# EasyEDA Pro project ProProject_Avaota Pi A_2024-03-25.epro, schematic Avaota Pi A, sheets 1 to 5 of 13 (continued)
## Sheets (continued)
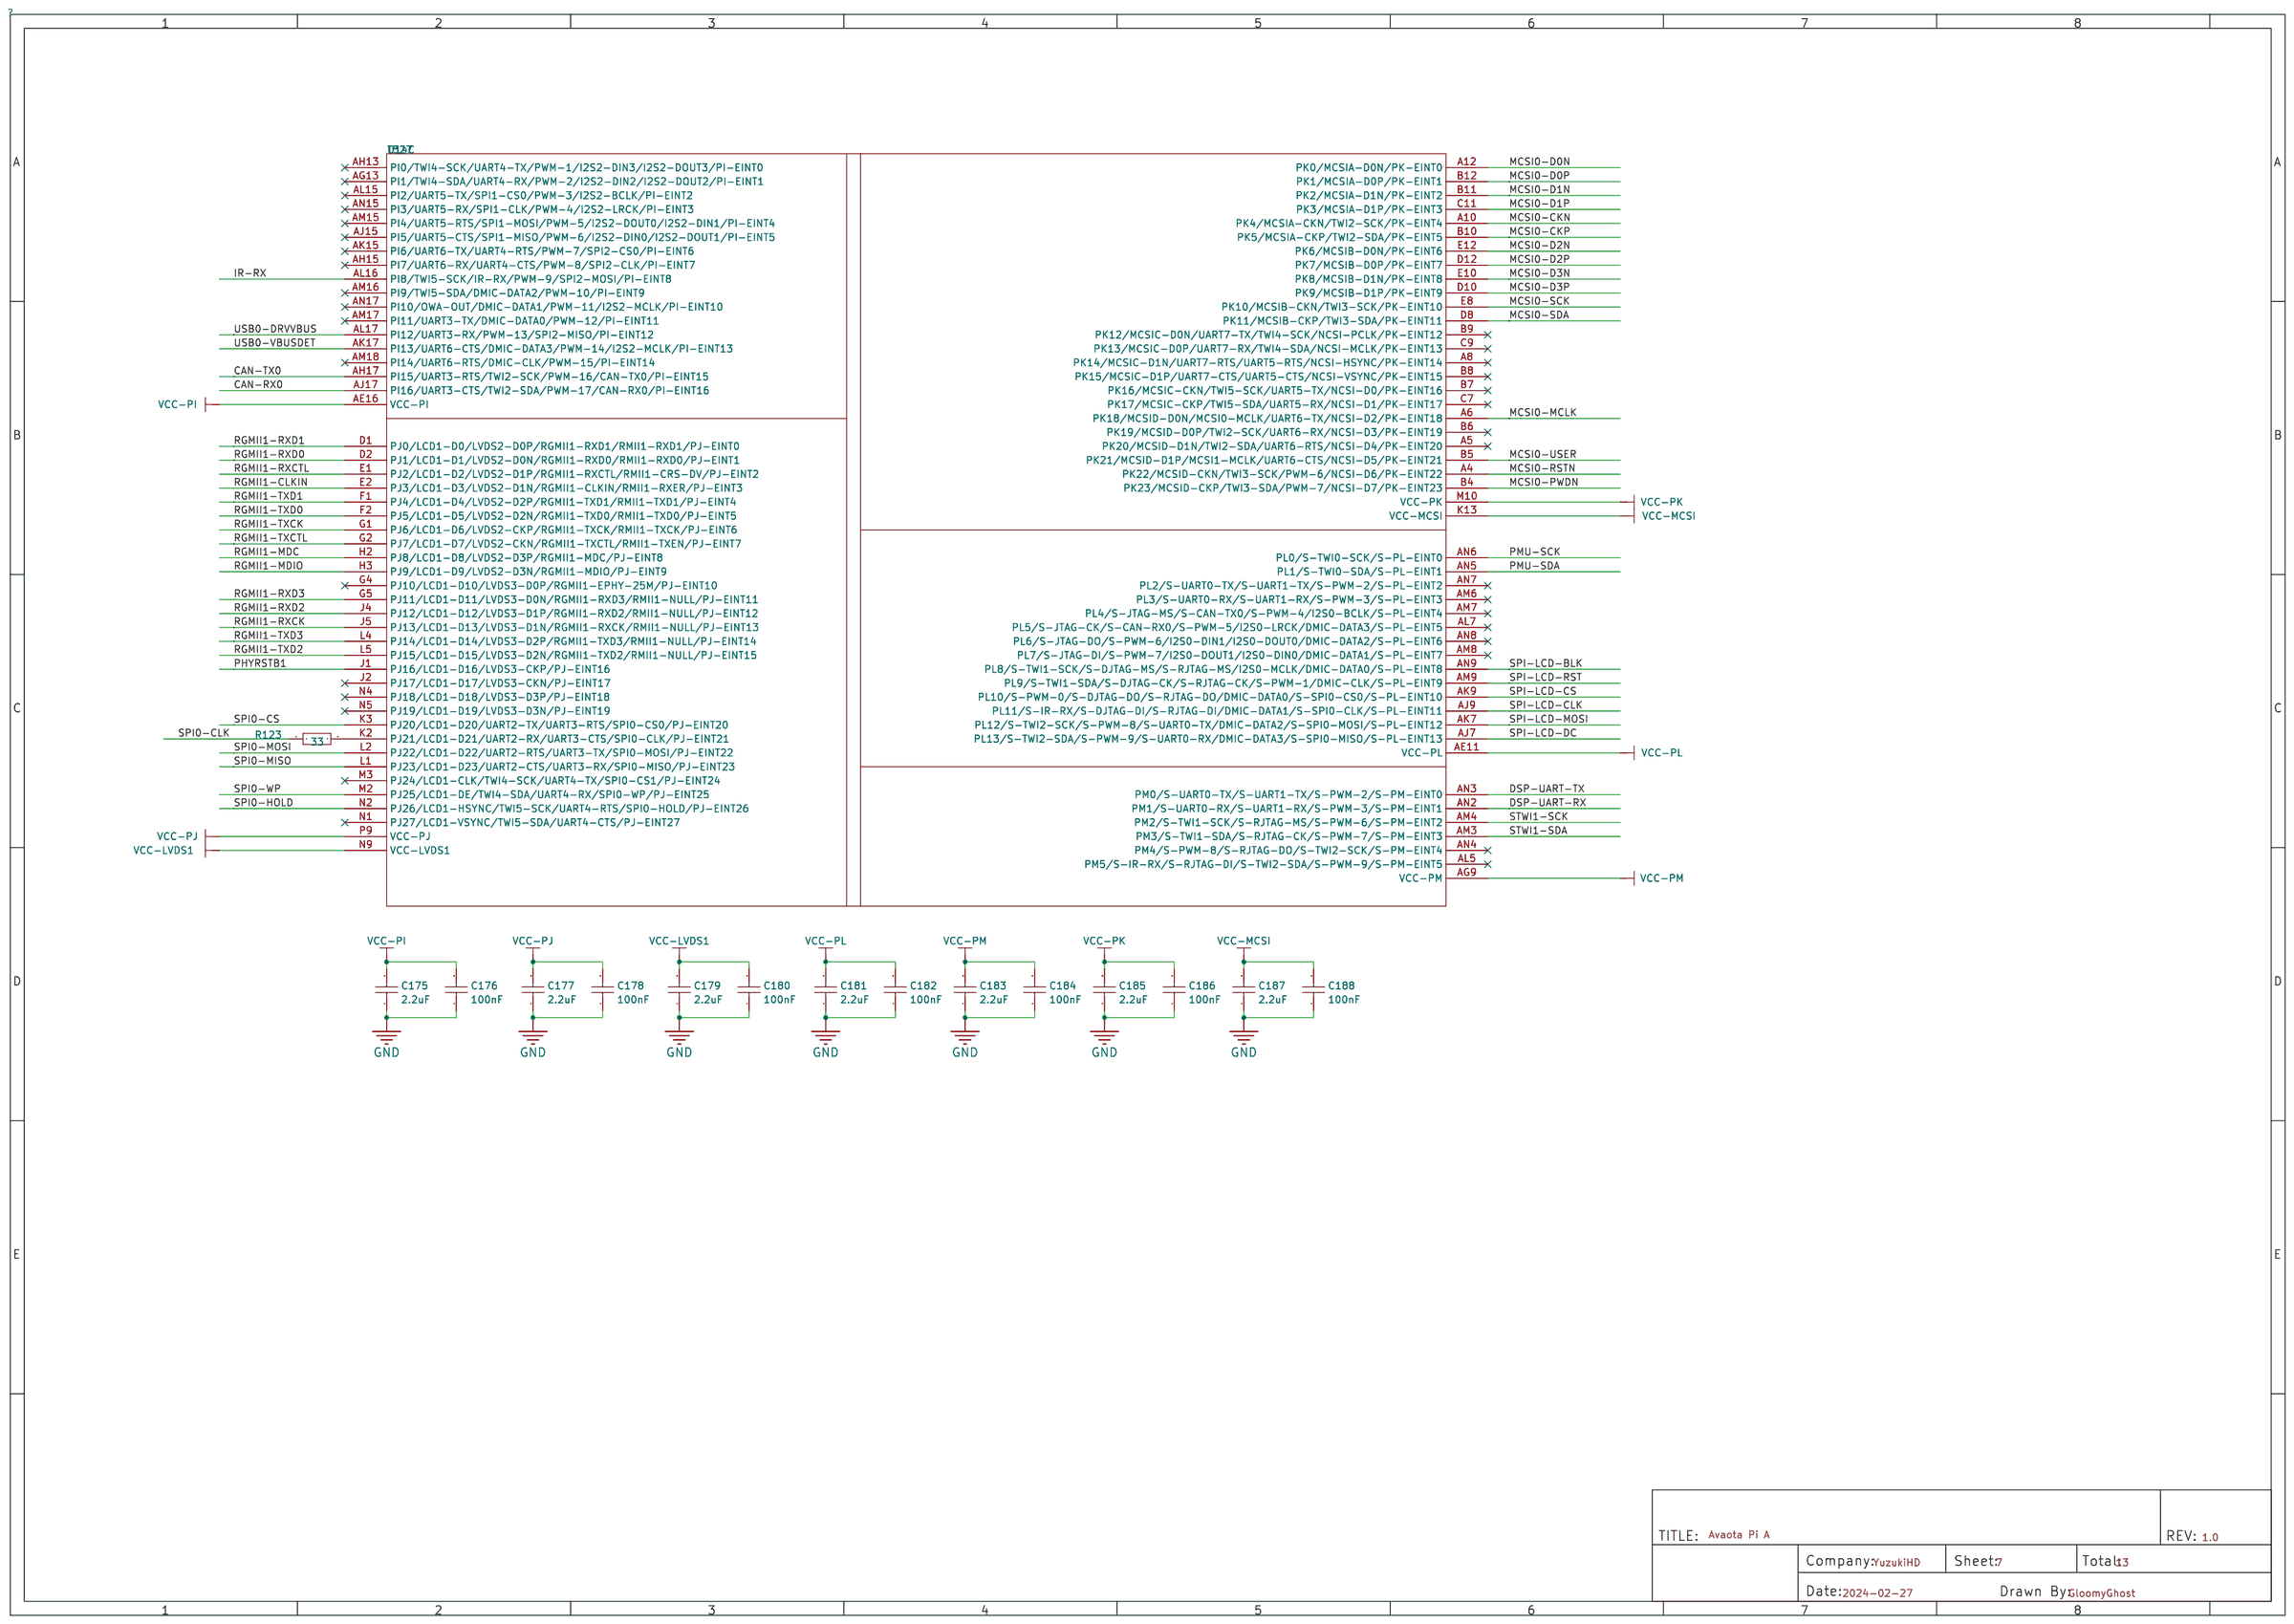
[diagram p6: GPIO2]

## Parts
sheet DRAM
C116  2.2uF  [c0201 nsk]
C117  2.2uF  [c0201 nsk]
C118  100nF  [c0201 nsk]
C119  100nF  [c0201 nsk]
C120  100nF  [c0201 nsk]
C121  100nF  [c0201 nsk]
C122  100nF  [c0201 nsk]
C123  100nF  [c0201 nsk]
C124  100nF  [c0201 nsk]
C125  100nF  [c0201 nsk]
C126  100nF  [c0201 nsk]
C127  100nF  [c0201 nsk]
C128  100nF  [c0201 nsk]
C129  100nF  [c0201 nsk]
C130  100nF  [c0201 nsk]
C131  100nF  [c0201 nsk]
C132  2.2uF  [c0201 nsk]
C133  100nF  [c0201 nsk]
C134  2.2uF  [c0201 nsk]
C135  100nF  [c0201 nsk]
C136  100nF  [c0201 nsk]
C137  100nF  [c0201 nsk]
C138  100nF  [c0201 nsk]
C139  100nF  [c0201 nsk]
C140  100nF  [c0201 nsk]
C141  100nF  [c0201 nsk]
C142  2.2uF  [c0201 nsk]
C143  2.2uF  [c0201 nsk]
C144  100nF  [c0201 nsk]
C145  100nF  [c0201 nsk]
C146  100nF  [c0201 nsk]
C147  2.2uF  [c0201 nsk]
C148  100nF  [c0201 nsk]
C149  100nF  [c0201 nsk]
C150  100nF  [c0201 nsk]
C151  100nF  [c0201 nsk]
C152  100nF  [c0201 nsk]
C153  100nF  [c0201 nsk]
C154  100nF  [c0201 nsk]
C155  100nF  [c0201 nsk]
C156  100nF  [c0201 nsk]
C157  100nF  [c0201 nsk]
C158  100nF  [c0201 nsk]
C159  100nF  [c0201 nsk]
C160  100nF  [c0201 nsk]
C161  2.2uF  [c0201 nsk]
C162  100nF  [c0201 nsk]
R36  0  [r0201 nsk]
R37  0  [r0201 nsk]
R38  120  [r0201 nsk]
R39  240  [r0201 nsk]
R40  240  [r0201 nsk]
UD1  LPDDR4_FBGA200  [BGA200P65_80B1000_1500H90]  (sections 1,2)
sheet GPIO1
C163  2.2uF  [c0201 nsk]
C164  100nF  [c0201 nsk]
C165  2.2uF  [c0201 nsk]
C166  100nF  [c0201 nsk]
C167  2.2uF  [c0201 nsk]
C168  100nF  [c0201 nsk]
C169  2.2uF  [c0201 nsk]
C170  100nF  [c0201 nsk]
C171  2.2uF  [c0201 nsk]
C172  100nF  [c0201 nsk]
C173  2.2uF  [c0201 nsk]
C174  100nF  [c0201 nsk]
R41  33  [r0201 nsk]
R42  33  [r0201 nsk]
R43  33  [r0201 nsk]
sheet GPIO2
C175  2.2uF  [c0201 nsk]
C176  100nF  [c0201 nsk]
C177  2.2uF  [c0201 nsk]
C178  100nF  [c0201 nsk]
C179  2.2uF  [c0201 nsk]
C180  100nF  [c0201 nsk]
C181  2.2uF  [c0201 nsk]
C182  100nF  [c0201 nsk]
C183  2.2uF  [c0201 nsk]
C184  100nF  [c0201 nsk]
C185  2.2uF  [c0201 nsk]
C186  100nF  [c0201 nsk]
C187  2.2uF  [c0201 nsk]
C188  100nF  [c0201 nsk]
R123  33  [r0201 nsk]
sheet POWER
C11  100nF  [c0201 nsk]
C12  1uF  [c0201 nsk]
C13  2.2uF  [c0201 nsk]
C14  2.2uF  [c0201 nsk]
C15  22uF  [c0402-nsk]
C16  22uF  [c0402-nsk]
C17  1uF  [c0201 nsk]
C18  22uF  [c0402-nsk]
C19  2.2uF  [c0201 nsk]
C20  2.2uF  [c0201 nsk]
C21  2.2uF  [c0201 nsk]
C22  2.2uF  [c0201 nsk]
C23  2.2uF  [c0201 nsk]
C24  2.2uF  [c0201 nsk]
C25  22uF  [c0402-nsk]
C26  22uF  [c0402-nsk]
C27  22uF  [C0603-NSK]
C28  22uF  [C0603-NSK]
C29  22uF  [c0402-nsk]
C30  1uF  [c0201 nsk]
C31  22uF  [c0402-nsk]
C32  22uF  [c0402-nsk]
C33  22uF  [c0402-nsk]
C34  22uF  [c0402-nsk]
C35  2.2uF  [c0201 nsk]
C36  2.2uF  [c0201 nsk]
C37  2.2uF  [c0201 nsk]
C38  2.2uF  [c0201 nsk]
C39  2.2uF  [c0201 nsk]
C40  2.2uF  [c0201 nsk]
C41  2.2uF  [c0201 nsk]
C42  22uF  [c0402-nsk]
C43  1uF  [c0201 nsk]
C44  22uF  [C0603-NSK]
C45  2.2uF  [c0201 nsk]
C46  2.2uF  [c0201 nsk]
C47  2.2uF  [c0201 nsk]
C48  2.2uF  [c0201 nsk]
C49  2.2uF  [c0201 nsk]
C50  2.2uF  [c0201 nsk]
C51  2.2uF  [c0201 nsk]
C52  2.2uF  [c0201 nsk]
C53  2.2uF  [c0201 nsk]
C54  2.2uF  [c0201 nsk]
C55  2.2uF  [c0201 nsk]
C56  2.2uF  [c0402-nsk]
C57  2.2uF  [c0201 nsk]
C58  2.2uF  [c0201 nsk]
C59  2.2uF  [c0201 nsk]
C60  2.2uF  [c0201 nsk]
C61  2.2uF  [c0201 nsk]
C62  2.2uF  [c0201 nsk]
C63  2.2uF  [c0201 nsk]
C64  2.2uF  [c0201 nsk]
C65  2.2uF  [c0201 nsk]
C66  2.2uF  [c0201 nsk]
C67  2.2uF  [c0201 nsk]
C68  2.2uF  [c0201 nsk]
C69  2.2uF  [c0201 nsk]
C70  4.7uF  [c0402-nsk]
C71  2.2uF  [c0201 nsk]
C72  22uF  [c0402-nsk]
C73  2.2uF  [c0201 nsk]
C74  22uF  [c0402-nsk]
C75  2.2uF  [c0201 nsk]
C76  2.2uF  [c0201 nsk]
C77  2.2uF  [c0201 nsk]
C78  2.2uF  [c0201 nsk]
C79  4.7uF  [c0402-nsk]
C80  22uF  [c0402-nsk]
C81  22uF  [c0402-nsk]
C82  4.7uF  [c0402-nsk]
C83  2.2uF  [c0201 nsk]
C84  2.2uF  [c0201 nsk]
C85  2.2uF  [c0201 nsk]
C86  2.2uF  [c0201 nsk]
C87  22uF  [c0402-nsk]
C88  1uF  [c0201 nsk]
C89  22uF  [c0402-nsk]
C283  22uF  [C0603-NSK]
C284  22uF  [C0603-NSK]
C285  22uF  [C0603-NSK]
C286  22uF  [C0603-NSK]
C287  22uF  [C0603-NSK]
C288  22uF  [C0603-NSK]
C289  22uF  [C0603-NSK]
C290  22uF  [C0603-NSK]
C291  22uF  [C0603-NSK]
C292  22uF  [C0603-NSK]
C293  22uF  [C0603-NSK]
L2  1uH  [ind-smd_l2.0-w1.6_1]
L3  1uH  [ind-smd_l2.0-w1.6_1]
L4  1uH  [ind-smd_l2.0-w1.6_1]
L5  1uH  [ind-smd_l2.0-w1.6_1]
L6  1uH  [ind-smd_l2.0-w1.6_1]
L7  1uH  [ind-smd_l2.0-w1.6_1]
L8  1uH  [ind-smd_l2.0-w1.6_1]
LED1  -  [RGBLED_0807]
R9  10K  [r0201 nsk]
R10  10K  [r0201 nsk]
R11  4K7  [r0201 nsk]
R12  4K7  [r0201 nsk]
R13  10K  [r0201 nsk]
R14  0  [r0201 nsk]
R17  1K  [r0201 nsk]
U4  AXP717  [QFN-52_L6.0-W6.0-P0.40-BL-EP3.4-1]
U5  AXP323  [QFN-20_L3.0-W3.0-P0.40-BL-EP1.5]
U14  T527  [T527-BGA664]  (sections Audio_ADC,DRAM,GND,IO_1,IO_2,PERF,SoC,VCC)
sheet SYSTEM
C90  100nF  [c0201 nsk]
C91  100nF  [c0201 nsk]
C92  100nF  [c0201 nsk]
C93  100nF  [c0201 nsk]
C94  1nF  [c0201 nsk]
C95  1nF  [c0201 nsk]
C96  1nF  [c0201 nsk]
C97  1nF  [c0201 nsk]
C98  22pF  [c0201 nsk]
C99  22pF  [c0201 nsk]
C100  22pF  [c0201 nsk]
C101  22pF  [c0201 nsk]
C102  100nF  [c0201 nsk]
C103  2.2uF  [c0201 nsk]
C104  2.2uF  [c0201 nsk]
C105  2.2uF  [c0201 nsk]
C106  10nF  [c0201 nsk]
C107  1nF  [c0201 nsk]
C108  2.2uF  [c0201 nsk]
C109  470nF  [c0201 nsk]
C110  470nF  [c0201 nsk]
C111  470nF  [c0201 nsk]
C112  470nF  [c0201 nsk]
C113  2.2uF  [c0201 nsk]
C114  2.2uF  [c0201 nsk]
C115  2.2uF  [c0201 nsk]
FAN  -  [FAN2510]
R19  10K  [r0201 nsk]
R20  10K  [r0201 nsk]
R21  1K  [r0201 nsk]
R22  1K  [r0201 nsk]
R23  1K  [r0201 nsk]
R24  0  [r0201 nsk]
R25  10M  [r0201 nsk]
R26  1K  [r0201 nsk]
R27  1K  [r0201 nsk]
R28  0  [R0402-NSK]
R30  10K  [r0201 nsk]
R31  NC  [r0201 nsk]
R32  10K  [r0201 nsk]
R33  3.9K  [r0201 nsk]
R34  10K  [r0201 nsk]
R35  NC  [r0201 nsk]
SW1  TS24CA  [SW-SMD_TS24CA]
SW2  TS24CA  [SW-SMD_TS24CA]
SW3  TS24CA  [SW-SMD_TS24CA]
X1  24MHz  [crystal-smd_4p-l2.0-w1.6-bl-nsk]
X2  32.768kHz  [osc-smd_l3.2-w1.5 nsk]

## Library data of the parts
C13 C14 C19-C24 C35-C41 C45-C55 C57-C69 C71 C73 C75-C78 C83-C86 C116 C117 C132 C134 C142 C143 C147 C161 = 0201X225M6R3NT: 容值:2.2uF;精度:±20%;额定电压:6.3V;材质(温度系数):X5R;; LCSC Part Name: 2.2uF ±20% 6.3V; Supplier Part: C285111; Manufacturer: FH(风华); Supplier Footprint: 0201; JLCPCB Part Class: 扩展库; Datasheet: https://atta.szlcsc.com/upload/public/pdf/source/20180913/C285111_405173511BA094D64E8CAA96F7E40A73.pdf; Supplier: LCSC; Tolerance: ±20%; Voltage Rated: 6.3V; Temperature Coefficient: X5R
C90-C97 C102-C115 C118-C131 C133 C135-C141 C144-C146 C148-C160 C162-C188 = GRM033R61A104KE15D: 容值:100nF;精度:±10%;额定电压:10V;材质(温度系数):X5R;; LCSC Part Name: 100nF ±10% 10V; Supplier Part: C76934; Manufacturer: muRata(村田); Supplier Footprint: 0201; JLCPCB Part Class: Extended Part; Datasheet: https://atta.szlcsc.com/upload/public/pdf/source/20180307/C76934_15204090982891407723.pdf; Supplier: LCSC; Tolerance: ±10%; Voltage Rated: 10V; Temperature Coefficient: X5R
R9-R14 R17 R19-R27 R30-R43 R123 = Res_0201: Supplier Footprint: 0201
UD1 = LPDDR4_FBGA200: SWAP_INFO: (S1+S2); SPLIT_INST: TRUE
C11 = GRM033R60J104KE19D: 容值:100nF;精度:±10%;额定电压:6.3V;材质(温度系数):X5R;; LCSC Part Name: 100nF ±10% 6.3V; Supplier Part: C76928; Manufacturer: muRata(村田); Supplier Footprint: 0201; JLCPCB Part Class: 扩展库; Datasheet: https://atta.szlcsc.com/upload/public/pdf/source/20180307/C76928_15204090936861407718.pdf; Supplier: LCSC; Tolerance: ±10%; Voltage Rated: 6.3V; Temperature Coefficient: X5R
C12 C17 C30 C43 C88 = GRM033R61A105ME44D: 容值:1uF;精度:±20%;额定电压:10V;材质(温度系数):X5R;; LCSC Part Name: 1uF ±20% 10V; Supplier Part: C76935; Manufacturer: muRata(村田); Supplier Footprint: 0201; JLCPCB Part Class: 扩展库; Datasheet: https://atta.szlcsc.com/upload/public/pdf/source/20190904/C426118_85E81C7C1F21FC87C5FB6D536E0847B4.pdf; Supplier: LCSC; Tolerance: ±20%; Voltage Rated: 10V; Temperature Coefficient: X5R
C15 C16 C18 C25 C26 C29 C31-C34 C42 C72 C74 C80 C81 C87 C89 = GRM155R60J226ME11D: 容值:22uF;精度:±20%;额定电压:6.3V;材质(温度系数):X5R;; LCSC Part Name: 22uF ±20% 6.3V; Supplier Part: C415703; Manufacturer: muRata(村田); Supplier Footprint: 0402; JLCPCB Part Class: 扩展库; Datasheet: https://atta.szlcsc.com/upload/public/pdf/source/20200305/C490387_23319AE8C154DEB24C505E6C82A8106A.pdf; Supplier: LCSC; Tolerance: ±20%; Voltage Rated: 6.3V; Temperature Coefficient: X5R
C27 C28 C44 C283-C293 = CL10A226MP8NUNE: 容值:22uF;精度:±20%;额定电压:10V;材质(温度系数):X5R;; LCSC Part Name: 22uF ±20% 10V; Supplier Part: C86295; Manufacturer: SAMSUNG(三星); Supplier Footprint: 0603; JLCPCB Part Class: 扩展库; Datasheet: https://atta.szlcsc.com/upload/public/pdf/source/20160218/1457707763339.pdf; Supplier: LCSC; Tolerance: ±20%; Voltage Rated: 10V; Temperature Coefficient: X5R
C56 = CL05A225KP5NSNC: 容值:2.2uF;精度:±10%;额定电压:10V;材质(温度系数):X5R;; LCSC Part Name: 2.2uF ±10% 10V; Supplier Part: C107369; Manufacturer: SAMSUNG(三星); Supplier Footprint: 0402; JLCPCB Part Class: Extended Part; Datasheet: https://atta.szlcsc.com/upload/public/pdf/source/20181106/C107369_263F7070671EA24F6B8C8282DA15FA22.pdf; Supplier: LCSC; Tolerance: ±10%; Voltage Rated: 10V; Temperature Coefficient: X5R
C70 C79 C82 = CL05A475KP5NRNC: 容值:4.7uF;精度:±10%;额定电压:10V;材质(温度系数):X5R;; LCSC Part Name: 4.7uF ±10% 10V; Supplier Part: C368809; Manufacturer: SAMSUNG(三星); Supplier Footprint: 0402; JLCPCB Part Class: 扩展库; Datasheet: https://atta.szlcsc.com/upload/public/pdf/source/20160218/1457707763339.pdf; Supplier: LCSC; Tolerance: ±10%; Voltage Rated: 10V; Temperature Coefficient: X5R
L2-L8 = TFM201610ALM-1R0MTAA: 电感值:1uH;精度:±20%;额定电流:3.1A;饱和电流(Isat):4.3A;直流电阻(DCR):50mΩ;; LCSC Part Name: 1uH ±20% 4.3A 50mΩ; Supplier Part: C598616; Manufacturer: TDK; Supplier Footprint: SMD,1.6x2mm; JLCPCB Part Class: 扩展库; Datasheet: https://atta.szlcsc.com/upload/public/pdf/source/20200701/C598616_EE42BAB5AE3B7612345364C4F9ECDC9F.pdf; Supplier: LCSC; Tolerance: ±20%; Rated Current: 3.1A; Saturation Current (Isat): 4.3A; DC Resistance (DCR): 50mΩ
LED1 = LED_0807-RGB: Supplier Footprint: 0805
U4 = AXP717B
U5 = AXP323
U14 = T527: Allwinner T527 SoC; SWAP_INFO: (S1+S2+S3+S4+S5+S6+S7+S8+S9); SPLIT_INST: TRUE
C98-C101 = 0201CG220J500NT: 容值:22pF;精度:±5%;额定电压:50V;材质(温度系数):C0G;; LCSC Part Name: 22pF ±5% 50V; Supplier Part: C57783; Manufacturer: FH(风华); Supplier Footprint: 0201; JLCPCB Part Class: 扩展库; Datasheet: https://atta.szlcsc.com/upload/public/pdf/source/20200305/C486355_26A10D38EF8C2A5C37091D0039909270.pdf; Supplier: LCSC; Tolerance: ±5%; Voltage Rated: 50V; Temperature Coefficient: C0G
FAN = FAN2510
R28 = Res_0402: Supplier Footprint: 0402
SW1-SW3 = TS24CA: 电路结构:单刀单掷;按钮形状:矩形按钮;安装方式:卧贴;开关长度:4.55mm;开关宽度:1.8mm;开关高度:3.5mm;触点电流:50mA;额定电压(DC):12V;带灯:-;机械寿命:-;; LCSC Part Name: 4.55*1.8*3.5mm 卧贴 轻触开关; Supplier Part: C393942; Manufacturer: SHOU HAN(首韩); Supplier Footprint: SMD; JLCPCB Part Class: 扩展库; Datasheet: https://atta.szlcsc.com/upload/public/pdf/source/20190521/C393942_591A9E318887EFA4274D34029981AD99.pdf; Supplier: LCSC; Circuit: 单刀单掷; Actuator Style: 矩形按钮; Mounting Style: 卧贴; Switch Length: 4.55mm; Switch Width: 1.8mm; Switch Height: 3.5mm; Contact Current: 50mA; Voltage Rating (DC): 12V
X1 = TAXM24M4ZDBCCT2T: 晶振类型:贴片无源晶振;频率:24MHz;常温频差:±20ppm;负载电容:10pF;频率稳定度(全温):±15ppm;; LCSC Part Name: 24MHz ±20ppm 10pF; Supplier Part: C388793; Manufacturer: YJX(雅晶鑫); Supplier Footprint: SMD2016-4P; JLCPCB Part Class: 扩展库; Datasheet: https://atta.szlcsc.com/upload/public/pdf/source/20190419/C388793_192353B16CD053644393BCEECA40F8D0.pdf; Supplier: LCSC; Crystal Type: 贴片无源晶振; Normal temperature Frequency Tolerance: ±20ppm; Load Capacitance: 10pF; Frequency Stability(Full temperature range): ±15ppm; Equivalent Series Resistance (ESR): 80Ω; Operating Temperature: -40℃~+85℃
X2 = Q13FC1350000400: 频率:32.768kHz;负载电容:12.5pF;频率公差:±20ppm;; LCSC Part Name: 32.768kHz ±20ppm 12.5pF; Supplier Part: C32346; Manufacturer: EPSON(爱普生); Supplier Footprint: SMD3215-2P; JLCPCB Part Class: 基础库; Datasheet: https://atta.szlcsc.com/upload/public/pdf/source/20190108/C32346_746D6B07EAF90824457A96480007685F.pdf; Supplier: LCSC; Crystal Type: 贴片无源晶振; Load Capacitance: 12.5pF; Equivalent Series Resistance (ESR): 70kΩ; Frequency Tolerance: ±20ppm; Operating Temperature: -40℃~+85℃

## Nets
AGND: C108.1 C109.1 C110.1 C111.1 R28.2 U14.AE3(AGND)
GND: C11.2 C12.2 C13.2 C14.2 C15.1 C16.1 C17.2 C18.1 C19.2 C20.2 C21.2 C22.2 C23.2 C24.2 C25.1 C26.2 C27.1 C28.1 C29.2 C30.2 C31.1 C32.2 C33.1 C34.2 C35.1 C36.2 C37.2 C38.2 C39.2 C40.2 C41.2 C42.2 C43.2 C44.1 C45.1 C46.2 C47.2 C48.2 C49.2 C50.2 C51.2 C52.2 C53.2 C54.2 C55.2 C56.1 C57.2 C58.2 C59.2 C60.1 C61.2 C62.1 C63.2 C64.1 C65.2 C66.1 C67.2 C68.2 C69.2 C70.1 C71.2 C72.1 C73.2 C74.1 C75.2 C76.2 C77.2 C78.2 C79.1 C80.1 C81.1 C82.1 C83.2 C84.2 C85.2 C86.2 C87.1 C88.2 C89.1 C90.1 C91.1 C92.1 C93.1 C94.1 C95.1 C96.1 C97.1 C98.1 C99.1 C100.1 C101.1 C102.1 C103.1 C104.1 C105.1 C106.1 C107.1 C112.1 C113.1 C114.1 C115.1 C116.2 C117.2 C118.1 C119.1 C120.1 C121.1 C122.1 C123.1 C124.1 C125.1 C126.1 C127.1 C128.1 C129.1 C130.1 C131.1 C132.2 C133.1 C134.2 C135.1 C136.1 C137.1 C138.1 C139.1 C140.1 C141.1 C142.2 C143.2 C144.1 C145.1 C146.1 C147.2 C148.1 C149.1 C150.1 C151.1 C152.1 C153.1 C154.1 C155.1 C156.1 C157.1 C158.1 C159.1 C160.1 C161.2 C162.1 C163.1 C164.1 C165.1 C166.1 C167.1 C168.1 C169.1 C170.1 C171.1 C172.1 C173.1 C174.1 C175.1 C176.1 C177.1 C178.1 C179.1 C180.1 C181.1 C182.1 C183.1 C184.1 C185.1 C186.1 C187.1 C188.1 C283.1 C284.1 C285.1 C286.1 C287.1 C288.1 C289.1 C290.1 C291.1 C292.1 C293.1 LED1.2(C) R13.1 R28.1 R33.1 R34.1 R35.1 SW1.1 SW1.2 SW1.3 SW2.1 SW2.2 SW2.3 SW3.1 SW3.2 SW3.3 U4.8(GND) U4.53(EPAD) U5.9(GND) U5.21(EPAD) U14.A1(GND0) U14.AA7(GND-ADC) U14.AA15(GND87) U14.AA16(GND88) U14.AA18(GND89) U14.AA21(GND90) U14.AA22(GND91) U14.AA26(GND92) U14.AA30(GND93) U14.AA32(GND94) U14.AB10(GND95) U14.AB11(GND96) U14.AB12(GND97) U14.AB14(GND98) U14.AB15(GND99) U14.AB17(GND100) U14.AC1(GND101) U14.AC26(GND102) U14.AC29(GND103) U14.AC33(GND104) U14.AD9(GND105) U14.AD11(GND106) U14.AD13(GND107) U14.AD14(GND108) U14.AD20(GND109) U14.AD21(GND110) U14.AD22(GND111) U14.AE9(GND112) U14.AE12(GND113) U14.AE14(GND114) U14.AE18(GND115) U14.AE19(GND116) U14.AE20(GND117) U14.AE21(GND118) U14.AE22(GND119) U14.AE23(GND120) U14.AE24(GND121) U14.AE25(GND122) U14.AE26(GND123) U14.AE29(GND124) U14.AE32(GND125) U14.AG3(GND126) U14.AG6(GND127) U14.AG7(GND128) U14.AG11(GND129) U14.AG25(GND130) U14.AG28(GND131) U14.AG31(GND132) U14.AG33(GND133) U14.AH7(GND134) U14.AH9(GND135) U14.AH27(GND136) U14.AH32(GND137) U14.AJ13(GND138) U14.AJ19(GND139) U14.AJ21(GND140) U14.AJ23(GND141) U14.AK5(GND142) U14.AK11(GND143) U14.AK32(GND144) U14.AL3(GND145) U14.AL9(GND146) U14.AL12(GND147) U14.AL13(GND148) U14.AL14(GND149) U14.AM5(GND150) U14.AM20(GND151) U14.AM26(GND152) U14.AM29(GND153) U14.AN1(GND154) U14.AN10(GND155) U14.AN11(GND156) U14.AN18(GND157) U14.AN22(GND158) U14.AN24(GND159) U14.AN28(GND160) U14.AN31(GND161) U14.AN33(GND162) U14.C6(GND1) U14.C8(GND2) U14.C10(GND3) U14.C12(GND4) U14.C14(GND5) U14.C18(GND6) U14.C20(GND7) U14.D6(GND8) U14.E3(GND9) U14.F6(GND10) U14.F8(GND11) U14.F10(GND12) U14.F12(GND13) U14.G3(GND14) U14.G8(GND15) U14.G10(GND16) U14.G14(GND17) U14.G18(GND18) U14.G29(GND19) U14.J3(GND20) U14.J6(GND21) U14.J9(GND22) U14.J10(GND23) U14.J12(GND24) U14.J13(GND25) U14.J28(GND26) U14.J31(GND27) U14.K9(GND28) U14.K10(GND29) U14.K11(GND30) U14.K12(GND31) U14.K26(GND32) U14.L3(GND33) U14.L6(GND34) U14.L10(GND35) U14.L12(GND36) U14.L13(GND37) U14.L27(GND38) U14.L30(GND39) U14.L33(GND40) U14.M13(GND41) U14.N3(GND42) U14.N6(GND43) U14.N10(GND44) U14.N12(GND45) U14.N15(GND46) U14.N18(GND47) U14.N19(GND48) U14.N22(GND49) U14.N26(GND50) U14.N27(GND51) U14.N30(GND52) U14.P11(GND53) U14.P16(GND54) U14.P19(GND55) U14.P24(GND56) U14.R3(GND57) U14.R7(GND58) U14.R11(GND59) U14.R13(GND60) U14.R19(GND61) U14.R24(GND62) U14.R27(GND63) U14.T15(GND64) U14.T16(GND65) U14.T18(GND66) U14.T24(GND67) U14.U7(GND68) U14.U14(GND69) U14.U16(GND70) U14.U25(GND71) U14.U27(GND72) U14.V18(GND73) U14.V19(GND74) U14.W12(GND75) U14.W13(GND76) U14.W15(GND77) U14.W16(GND78) U14.W22(GND79) U14.W27(GND80) U14.W30(GND81) U14.Y10(VREFN-ADC) U14.Y15(GND82) U14.Y18(GND83) U14.Y22(GND84) U14.Y23(GND85) U14.Y26(GND86) UD1.A3(VSS0) UD1.A10(VSS1) UD1.AB3(VSS54) UD1.AB5(VSS55) UD1.AB8(VSS56) UD1.AB10(VSS57) UD1.C1(VSS2) UD1.C5(VSS3) UD1.C8(VSS4) UD1.C12(VSS5) UD1.D2(VSS6) UD1.D4(VSS7) UD1.D9(VSS8) UD1.D11(VSS9) UD1.E1(VSS10) UD1.E5(VSS11) UD1.E8(VSS12) UD1.E12(VSS13) UD1.G1(VSS14) UD1.G3(VSS15) UD1.G5(VSS16) UD1.G8(VSS17) UD1.G10(VSS18) UD1.G12(VSS19) UD1.J1(VSS20) UD1.J3(VSS21) UD1.J10(VSS22) UD1.J12(VSS23) UD1.K2(VSS24) UD1.K4(VSS25) UD1.K9(VSS26) UD1.K11(VSS27) UD1.N2(VSS28) UD1.N4(VSS29) UD1.N9(VSS30) UD1.N11(VSS31) UD1.P1(VSS32) UD1.P3(VSS33) UD1.P10(VSS34) UD1.P12(VSS35) UD1.T1(VSS36) UD1.T3(VSS37) UD1.T5(VSS38) UD1.T8(VSS39) UD1.T10(VSS40) UD1.T12(VSS41) UD1.V1(VSS42) UD1.V5(VSS43) UD1.V8(VSS44) UD1.V12(VSS45) UD1.W2(VSS46) UD1.W4(VSS47) UD1.W9(VSS48) UD1.W11(VSS49) UD1.Y1(VSS50) UD1.Y5(VSS51) UD1.Y8(VSS52) UD1.Y12(VSS53) X1.2(GND) X1.4(GND) ; also on sheet 6 8 9 10 11 12 13
VBUS: C27.2 C28.2 U4.49(VBUS_1) U4.50(VBUS_2) ; also on sheet 6 8 11 12
VCC-LDO-RTC: C45.2 C92.2 R9.1 R10.1 U4.35(VRTC) U14.AE13(VCC-RTC)
VDD-CPUBFB: U5.1(DCDC2) U5.16(DCDC1) U14.R22(VDD-CPUBFB)
VDD-CPULFB: U4.12(FB1) U14.AA19(VDD-CPULFB)
VDD-DNRFB: U5.4(DCDC3) U14.AB13(VDD-DNRFB)
VDD-SYSFB: U4.34(FB2) U14.P18(VDD-SYSFB)
323-ALDO1: C69.1 U5.15(ALDO1)
323-DCDC1/2: C19.1 C20.1 C21.1 C22.1 C23.1 C24.1 C72.2 C74.2 C80.2 C81.2 L6.2 L7.2 U14.T19(VDD-CPUB0) U14.T21(VDD-CPUB1) U14.T22(VDD-CPUB2) U14.U18(VDD-CPUB3) U14.U19(VDD-CPUB4) U14.U21(VDD-CPUB5) U14.U22(VDD-CPUB6)
323-DCDC3: C83.1 C84.1 C85.1 C86.1 C87.2 C89.2 L8.2 U14.AA12(VDD-DNR2) U14.AA13(VDD-DNR3) U14.Y12(VDD-DNR0) U14.Y13(VDD-DNR1)
323-DLDO1: C71.1 U5.12(DLDO1)
323-RTCLDO: C73.1 U5.7(RTCLDO)
ADCIN0: C106.2 R26.2 U14.W9(ADCIN0)
ADCIN1: C107.2 R27.2 U14.W10(ADCIN1)
ALDO1: C51.1 U4.13(ALDO1)
ALDO2: C52.1 U4.14(ALDO2)
ALDO3: C53.1 C181.2 C182.2 C183.2 C184.2 R11.1 R12.1 U4.16(ALDO3) U14.AE11(VCC-PL) U14.AG9(VCC-PM)
ALDO4: C54.1 C90.2 C93.2 C108.2 C114.2 C132.1 C133.2 C161.1 C162.2 R19.2 R20.2 R24.2 R30.2 R31.2 R32.2 U4.17(ALDO4) U14.AB9(AVCC) U14.AD15(VCC-DCXO) U14.AD25(VDD18-DRAM) U14.AG15(VCC-PLL) U14.W7(VCC-ADC)
ALDO-OUT: C103.2 U14.AE7(ALDO-OUT)
AP-NMI: C94.2 R10.2 U4.37(IRQ) U5.11(IRQ) U14.AM10(NMI)
AP-RESET: C95.2 R9.2 R21.2 U4.1(PWROK) U5.13(PWROK) U14.AJ11(RESET)
AP-WAKE-BT: U14.U4(PG11/I2S1-BCLK/PG-EINT11) ; also on sheet 12
BLDO1: C59.1 C165.2 C166.2 C171.2 C172.2 C179.2 C180.2 R17.2 U4.18(BLDO1) U14.N9(VCC-LVDS1) U14.N24(VCC-LVDS0) U14.T9(VCC-PG) ; also on sheet 12
BLDO2: C61.1 C134.1 C135.2 C136.2 C137.2 C138.2 C139.2 C140.2 C141.2 U4.19(BLDO2) U5.14(PWRON) UD1.F1(VDD1-0) UD1.F12(VDD1-1) UD1.G4(VDD1-2) UD1.G9(VDD1-3) UD1.T4(VDD1-4) UD1.T9(VDD1-5) UD1.U1(VDD1-6) UD1.U12(VDD1-7)